# EasyEDA Pro project 3SE_24_Power_Rune.eprj, board Armour_Demo2.0
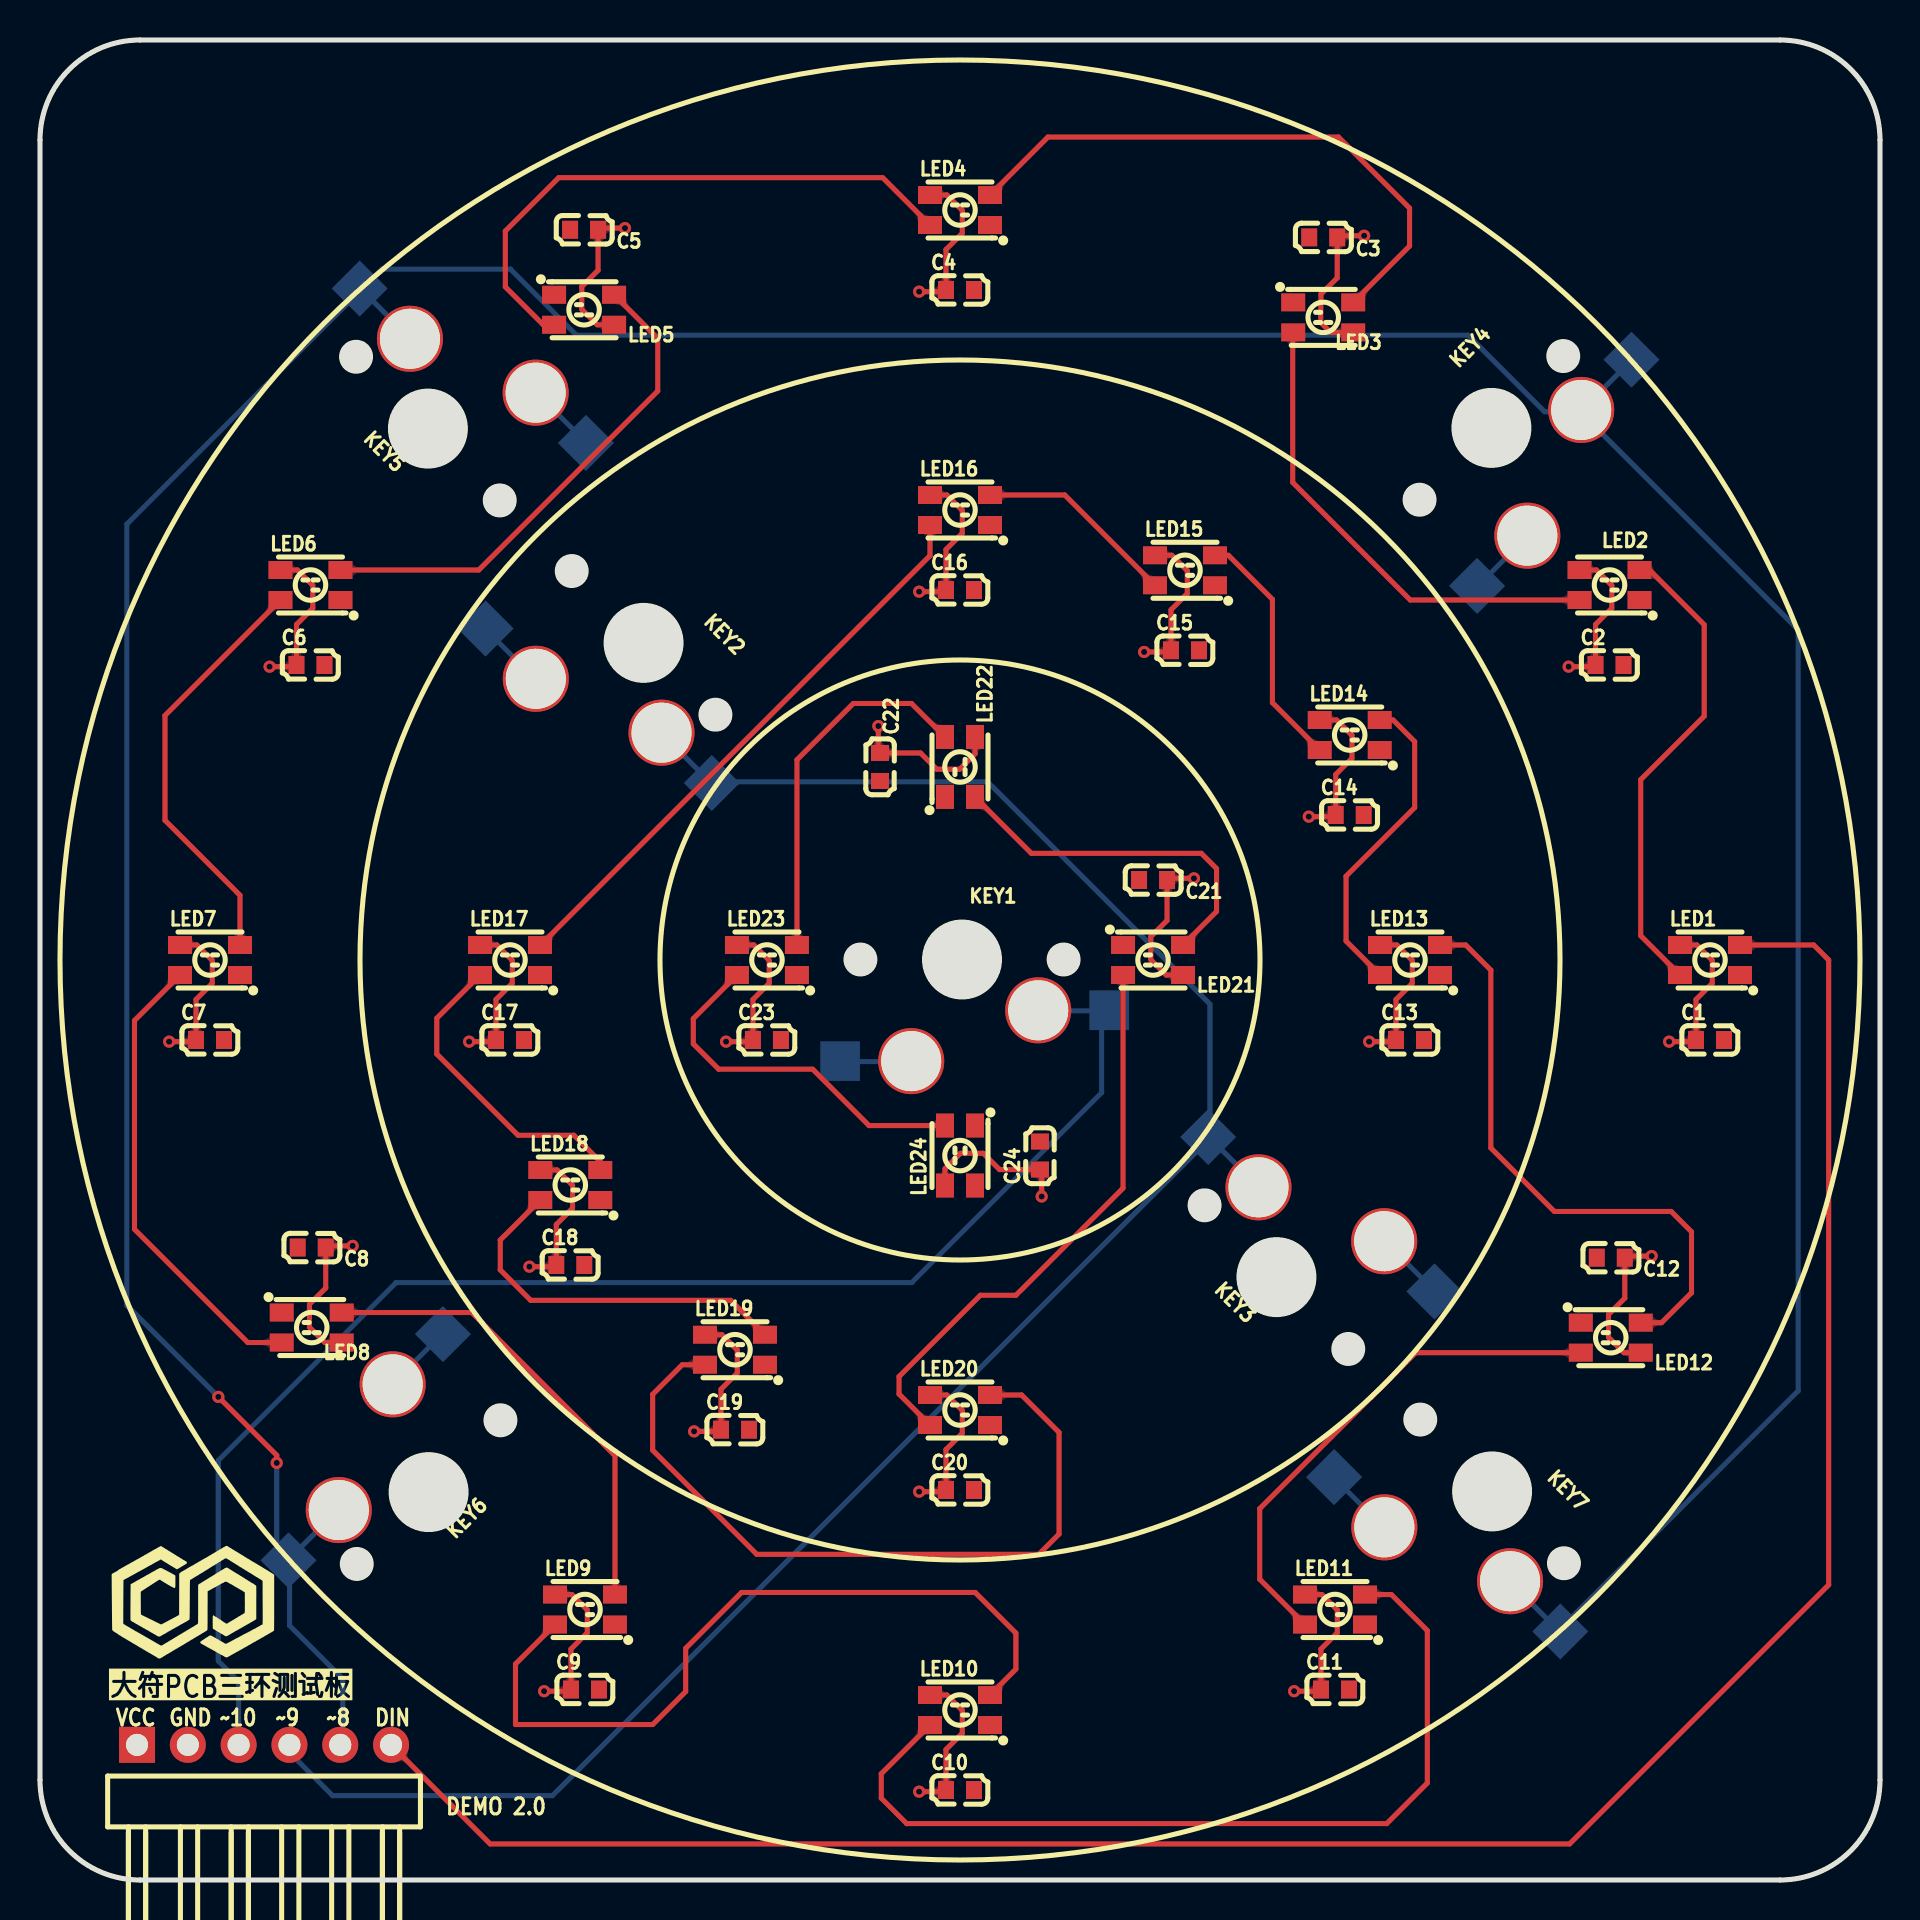
[diagram p13: board, top side]
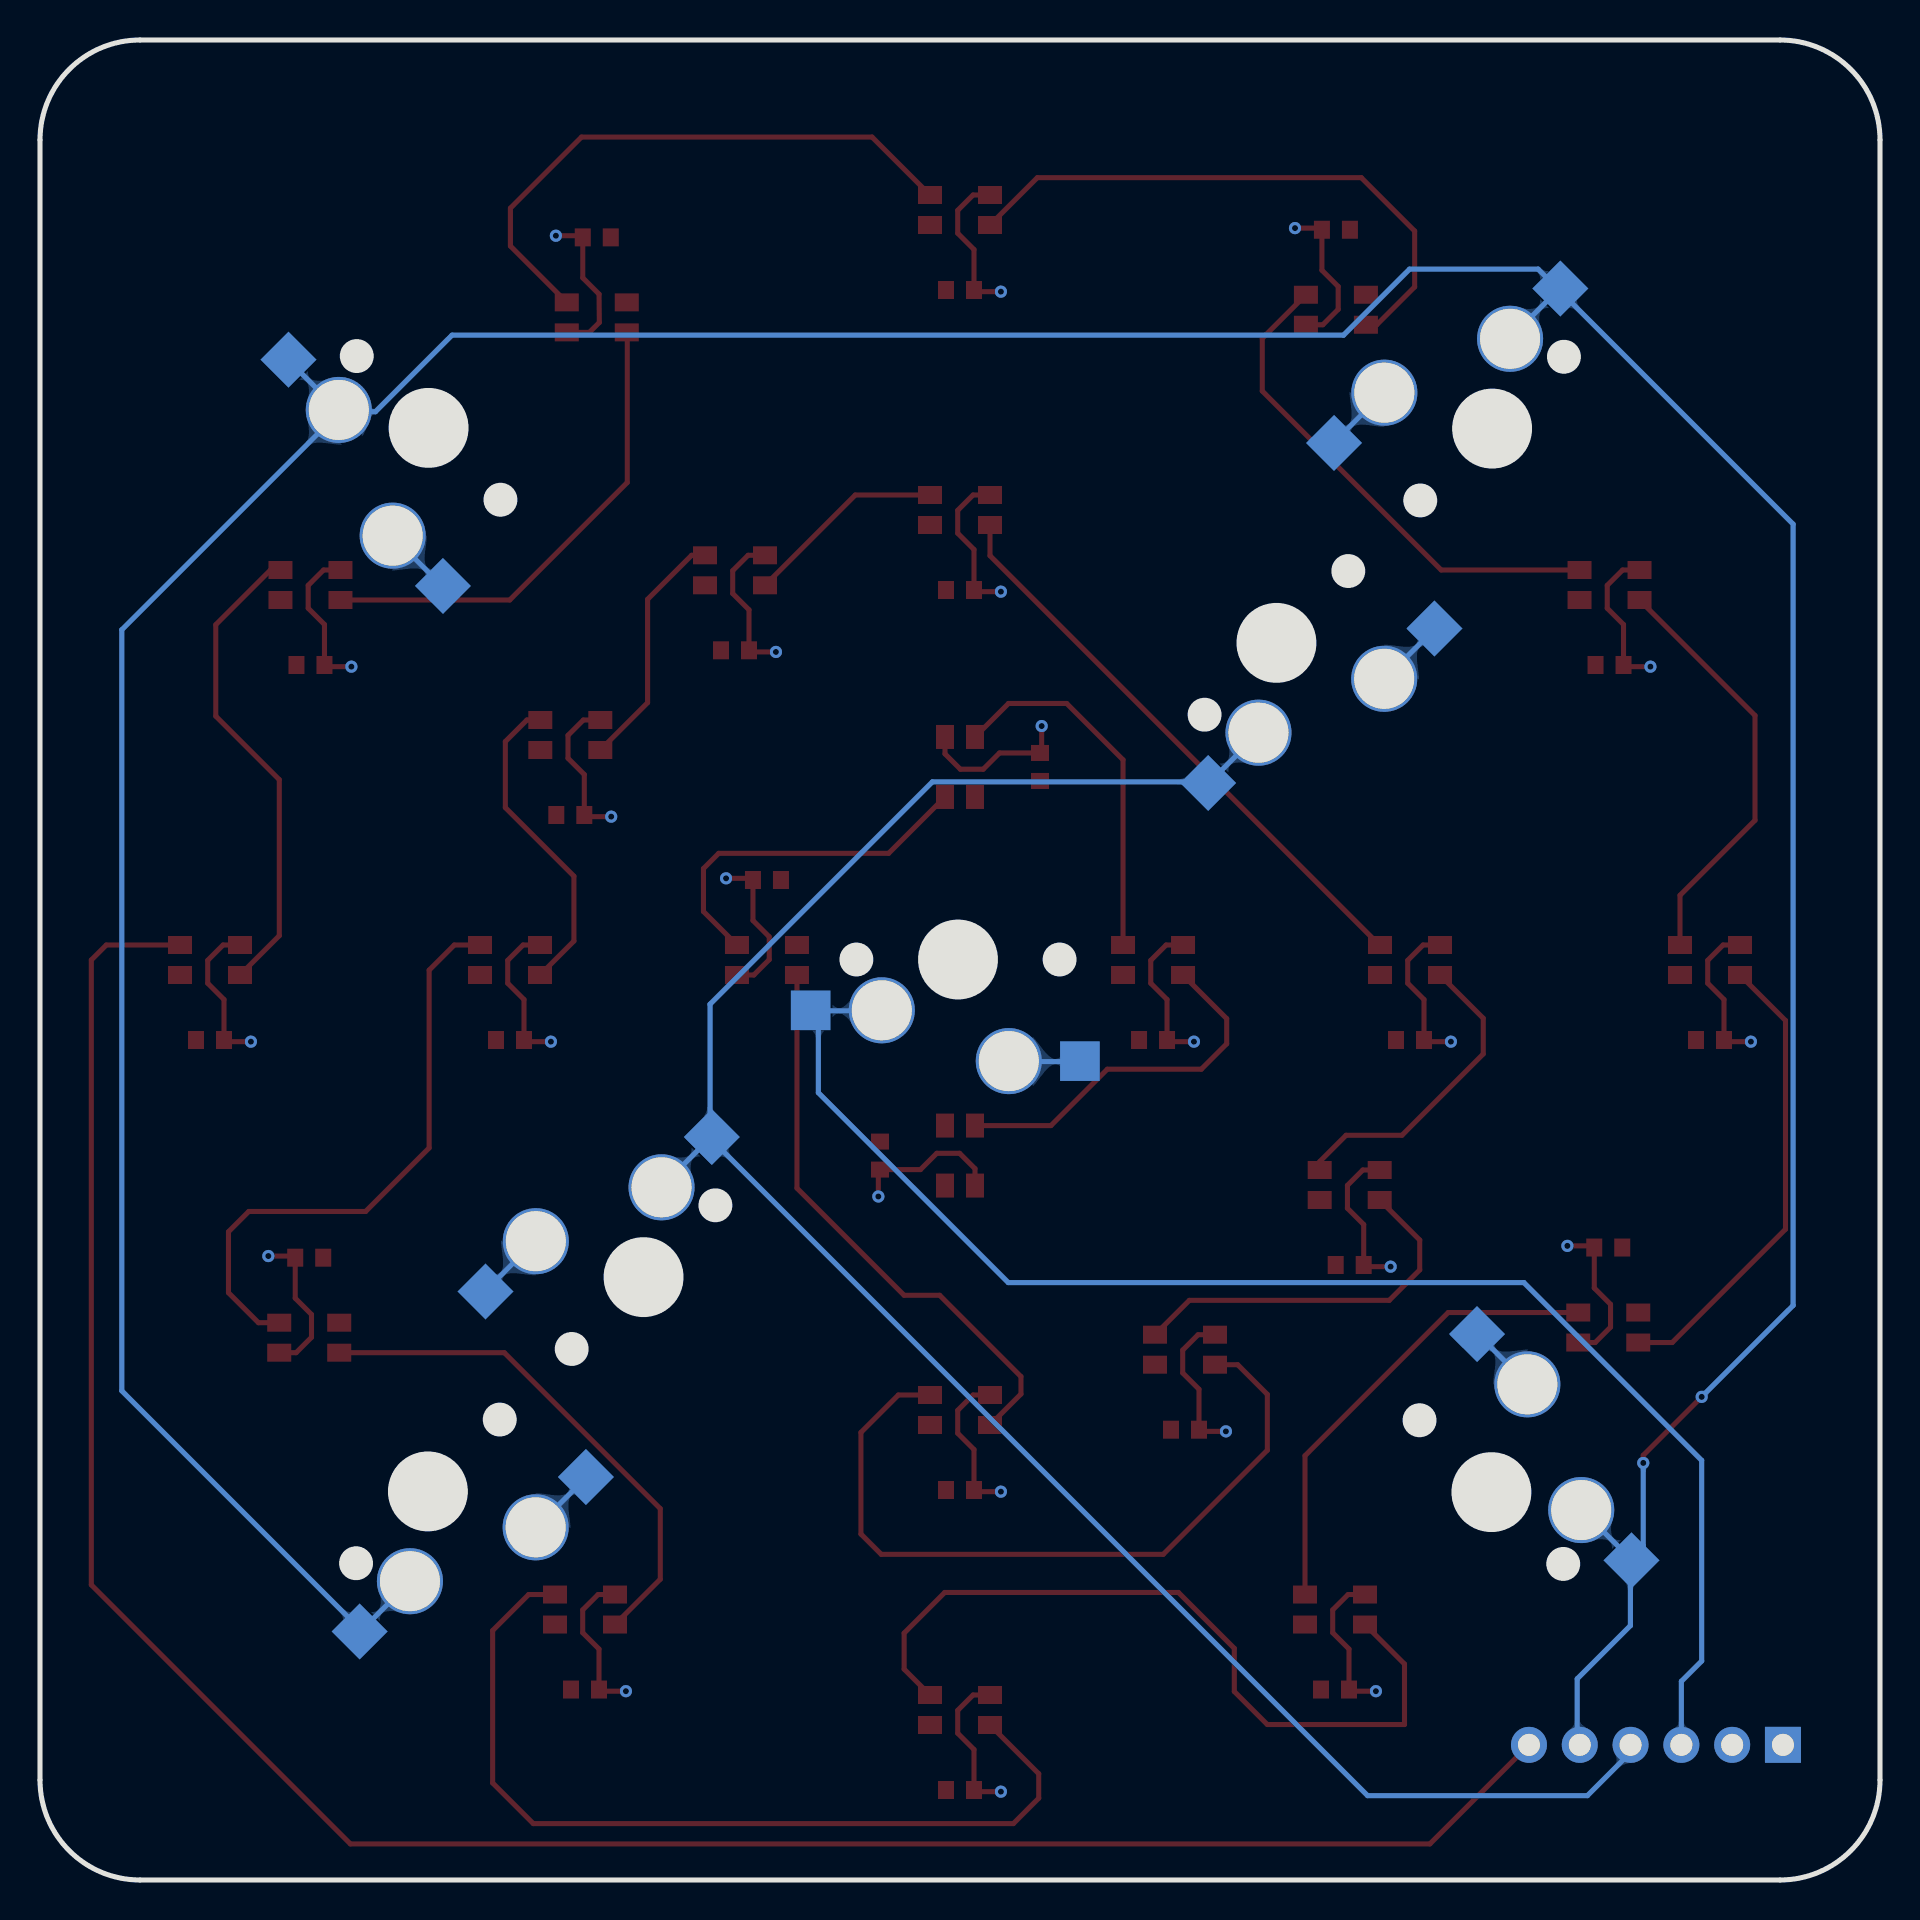
[diagram p14: board, bottom side, seen from below]

Outline 92 x 92 mm; copper layers: Top Layer, Bottom Layer. Coordinates in mm from the lower left corner of the outline.
Outline path: 0,87 0,5 arc(1.46,1.46) 5,0 87,0 arc(90.54,1.46) 92,5 92,87 arc(90.54,90.54) 87,92 5,92 arc(1.46,90.54) 0,87
Stack: Top Layer 0.035mm / Dielectric1 1.51mm FR4 er 4.5 / Bottom Layer 0.035mm

## Design rules (mm)
template: 自定义配置
spacing copperThickness1oz (default): track to track 0.102, other pairs 0.152 to 0.3
spacing copperThickness2oz: track to track 0.203, other pairs 0.152 to 0.3
track width copperThickness1oz (default): min 0.127, default 0.254, max 2.54
track width copperThickness2oz: min 0.203, default 0.254, max 2.54
differential pair differentialPair (default): width min 0.127, default 0.254, max 2.54; gap min 0.152, default 0.152
via viaSize (default): diameter min 0.5, default 0.61, max 10; hole min 0.3, default 0.305, max 6.3
net GND uses power
net VCC uses power

## Placement (name value [footprint] x y rotation side)
C1  100nF  [C0603]  83.5 42 0 top
C2  100nF  [C0603]  78.48 60.75 0 top
C3  100nF  [C0603]  64.16 82.13 180 top
C4  100nF  [C0603]  46 79.5 0 top
C5  100nF  [C0603]  27.2 82.51 180 top
C6  100nF  [C0603]  13.52 60.75 0 top
C7  100nF  [C0603]  8.5 42 0 top
C8  100nF  [C0603]  13.59 31.62 180 top
C9  100nF  [C0603]  27.25 9.52 0 top
C10  100nF  [C0603]  46 4.5 0 top
C11  100nF  [C0603]  64.75 9.52 0 top
C12  100nF  [C0603]  78.54 31.11 180 top
C13  100nF  [C0603]  68.5 42 0 top
C14  100nF  [C0603]  65.49 53.25 0 top
C15  100nF  [C0603]  57.25 61.49 0 top
C16  100nF  [C0603]  46 64.5 0 top
C17  100nF  [C0603]  23.5 42 0 top
C18  100nF  [C0603]  26.51 30.75 0 top
C19  100nF  [C0603]  34.75 22.51 0 top
C20  100nF  [C0603]  46 19.5 0 top
C21  100nF  [C0603]  55.65 50 180 top
C22  100nF  [C0603]  42 55.65 270 top
C23  100nF  [C0603]  36.35 42 0 top
C24  100nF  [C0603]  50 36.22 90 top
H1  PZ254R-11-06P  [HDR-TH_6P-P2.54-H-M-W10.4]  11.2 6.76 0 top
KEY1  -  [热插拔轴座]  46 46 0 top
KEY2  -  [热插拔轴座]  30.09 61.91 315 top
KEY3  -  [热插拔轴座]  61.91 30.09 135 top
KEY4  -  [热插拔轴座]  72.52 72.52 45 top
KEY5  -  [热插拔轴座]  19.48 72.52 135 top
KEY6  -  [热插拔轴座]  19.48 19.48 225 top
KEY7  -  [热插拔轴座]  72.52 19.48 315 top
LED1  XL-3528RGBW-WS2812B  [LED-SMD_4P-L3.5-W2.8-BR-1]  83.5 46 0 top
LED2  XL-3528RGBW-WS2812B  [LED-SMD_4P-L3.5-W2.8-BR-1]  78.48 64.75 0 top
LED3  XL-3528RGBW-WS2812B  [LED-SMD_4P-L3.5-W2.8-BR-1]  64.16 78.13 180 top
LED4  XL-3528RGBW-WS2812B  [LED-SMD_4P-L3.5-W2.8-BR-1]  46 83.5 0 top
LED5  XL-3528RGBW-WS2812B  [LED-SMD_4P-L3.5-W2.8-BR-1]  27.2 78.51 180 top
LED6  XL-3528RGBW-WS2812B  [LED-SMD_4P-L3.5-W2.8-BR-1]  13.52 64.75 0 top
LED7  XL-3528RGBW-WS2812B  [LED-SMD_4P-L3.5-W2.8-BR-1]  8.5 46 0 top
LED8  XL-3528RGBW-WS2812B  [LED-SMD_4P-L3.5-W2.8-BR-1]  13.59 27.62 180 top
LED9  XL-3528RGBW-WS2812B  [LED-SMD_4P-L3.5-W2.8-BR-1]  27.25 13.52 0 top
LED10  XL-3528RGBW-WS2812B  [LED-SMD_4P-L3.5-W2.8-BR-1]  46 8.5 0 top
LED11  XL-3528RGBW-WS2812B  [LED-SMD_4P-L3.5-W2.8-BR-1]  64.75 13.52 0 top
LED12  XL-3528RGBW-WS2812B  [LED-SMD_4P-L3.5-W2.8-BR-1]  78.54 27.12 180 top
LED13  XL-3528RGBW-WS2812B  [LED-SMD_4P-L3.5-W2.8-BR-1]  68.5 46 0 top
LED14  XL-3528RGBW-WS2812B  [LED-SMD_4P-L3.5-W2.8-BR-1]  65.49 57.25 0 top
LED15  XL-3528RGBW-WS2812B  [LED-SMD_4P-L3.5-W2.8-BR-1]  57.25 65.49 0 top
LED16  XL-3528RGBW-WS2812B  [LED-SMD_4P-L3.5-W2.8-BR-1]  46 68.5 0 top
LED17  XL-3528RGBW-WS2812B  [LED-SMD_4P-L3.5-W2.8-BR-1]  23.5 46 0 top
LED18  XL-3528RGBW-WS2812B  [LED-SMD_4P-L3.5-W2.8-BR-1]  26.51 34.75 0 top
LED19  XL-3528RGBW-WS2812B  [LED-SMD_4P-L3.5-W2.8-BR-1]  34.75 26.51 0 top
LED20  XL-3528RGBW-WS2812B  [LED-SMD_4P-L3.5-W2.8-BR-1]  46 23.5 0 top
LED21  XL-3528RGBW-WS2812B  [LED-SMD_4P-L3.5-W2.8-BR-1]  55.65 46 180 top
LED22  XL-3528RGBW-WS2812B  [LED-SMD_4P-L3.5-W2.8-BR-1]  46 55.65 270 top
LED23  XL-3528RGBW-WS2812B  [LED-SMD_4P-L3.5-W2.8-BR-1]  36.35 46 0 top
LED24  XL-3528RGBW-WS2812B  [LED-SMD_4P-L3.5-W2.8-BR-1]  46 36.22 90 top

## Footprints (pads in the part's own frame, mm; a bottom-side part is the same pattern mirrored in y, then rotated)
C0603
  rect 0.8x0.9 smd: 1(-0.7,0) 2(0.7,0)
HDR-TH_6P-P2.54-H-M-W10.4
  rect 1.8x1.8 hole 1.1: 1(-6.35,0)
  round 1.8 hole 1.1: 2(-3.81,0) 3(-1.27,0) 4(1.27,0) 5(3.81,0) 6(6.35,0)
LED-SMD_4P-L3.5-W2.8-BR-1
  rect 1.2x0.9 smd: 1(1.5,-0.75) 2(1.5,0.75) 3(-1.5,0.75) 4(-1.5,-0.75)
热插拔轴座
  rect 1.981x1.981 smd far side: 1(-5.995,-5.056) 2(7.466,-2.515)
  round 3.304 hole 3: 1(-2.439,-5.056) 2(3.91,-2.515)

## Nets
As in the schematic.

## Via types
v1: diameter 0.61, hole 0.305, Top Layer to Bottom Layer, 26 vias

## Routing (per net, layer and track width the routed paths; a pad name or vN(x,y) marks a point on that pad's centre or on a via; arc(x,y) is an arc through that point)
GND: length 24.9
  Bottom Layer w0.254: 69.81,29.37 67.3,31.89 ; 64.61,20.2 67.13,17.69 ; 22.19,62.63 24.7,60.11 ; 74.31,67.13 71.8,64.61 ; 27.39,71.8 24.87,74.31 ; 20.2,27.39 17.69,24.87 ; 43.46,40.92 39.9,40.92
VCC: length 183.3
  Top Layer w0.254: LED5.3 27.86,77.76 27.09,78.53 27.09,79.67 27.9,80.49 C5.1 27.99,82.59 v1(29.25,82.59) ; LED10.3 45.34,9.25 46.11,8.48 46.11,7.34 45.3,6.52 C10.1 45.22,4.42 v1(43.96,4.42) ; v1(21.45,41.92) 22.72,41.92 C17.1 22.8,44.02 23.61,44.84 23.61,45.98 22.84,46.75 LED17.3 ; v1(11.48,60.67) 12.74,60.67 C6.1 12.82,62.77 13.64,63.59 13.64,64.73 12.87,65.5 LED6.3 ; LED7.3 7.84,46.75 8.61,45.98 8.61,44.84 7.8,44.02 C7.1 7.72,41.92 v1(6.45,41.92) ; LED19.3 34.09,27.26 34.86,26.5 34.86,25.35 34.05,24.54 C19.1 33.97,22.43 v1(32.71,22.43) ; v1(34.3,41.92) 35.56,41.92 C23.1 35.65,44.02 36.46,44.84 36.46,45.98 35.69,46.75 LED23.3 ; v1(50.08,34.18) 50.08,35.44 C24.1 47.98,35.52 47.16,36.33 46.02,36.33 45.25,35.57 LED24.3 ; v1(41.92,57.7) 41.92,56.44 C22.1 44.02,56.35 44.84,55.54 45.98,55.54 46.75,56.31 LED22.3 ; LED16.3 45.34,69.25 46.11,68.48 46.11,67.34 45.3,66.52 C16.1 45.22,64.42 v1(43.96,64.42) ; v1(66.21,82.21) 64.94,82.21 C3.1 64.86,80.11 64.05,79.29 64.03,77.88 64.53,77.38 LED3.3 ; v1(25.21,9.44) 26.47,9.44 C9.1 26.55,11.55 27.36,12.36 27.36,13.5 26.59,14.27 LED9.3 ; v1(76.43,60.67) 77.69,60.67 C2.1 77.78,62.77 78.59,63.59 78.59,64.73 77.82,65.5 LED2.3 ; LED21.3 56.31,45.25 55.54,46.02 55.54,47.16 56.35,47.98 C21.1 56.44,50.08 v1(57.7,50.08) ; v1(62.71,9.44) 63.97,9.44 C11.1 64.05,11.55 64.86,12.36 64.86,13.5 64.09,14.27 LED11.3 ; LED8.3 14.24,26.87 13.47,27.64 13.47,28.78 14.29,29.6 C8.1 14.37,31.71 v1(15.63,31.71) ; v1(80.58,31.2) 79.32,31.2 79.24,31.11 79.24,29.09 78.43,28.28 78.43,27.13 79.19,26.37 LED12.3 ; LED1.3 82.84,46.75 83.61,45.98 83.61,44.84 82.8,44.02 C1.1 82.72,41.92 v1(81.46,41.92) ; LED14.3 64.83,58 65.6,57.23 65.6,56.09 64.79,55.27 C14.1 64.7,53.17 v1(63.44,53.17) ; v1(55.21,61.4) 56.47,61.4 C15.1 56.55,63.51 57.36,64.32 57.36,65.47 56.59,66.24 LED15.3 ; v1(66.46,41.92) 67.72,41.92 C13.1 67.8,44.02 68.61,44.84 68.61,45.98 67.84,46.75 LED13.3 ; LED4.3 45.34,84.25 46.11,83.48 46.11,82.34 45.3,81.52 C4.1 45.22,79.42 v1(43.96,79.42) ; LED18.3 25.86,35.5 26.63,34.73 26.63,33.59 25.81,32.77 C18.1 25.73,30.67 v1(24.47,30.67) ; v1(43.96,19.42) 45.22,19.42 C20.1 45.3,21.52 46.11,22.34 46.11,23.48 45.34,24.25 LED20.3
DIN1: length 115.3
  Top Layer w0.254: H1.6 22.5,1.8 76.48,1.8 89.43,14.76 89.43,46 88.68,46.75 LED1.2
KEY8: length 231.1
  Top Layer w0.254: v1(8.92,24.16) 11.84,21.24 v1(11.84,20.85)
  Bottom Layer w0.254: H1.5 15.14,6.88 15.14,10.06 12.48,12.72 12.48,16.07 ; 14.99,18.59 12.48,16.07 ; 12.48,16.07 11.84,16.71 v1(11.84,20.85) ; v1(8.92,24.16) 4.34,28.73 4.34,67.79 16.07,79.52 ; 16.07,79.52 17.09,80.54 23.52,80.54 26.82,77.24 71.4,77.24 75.23,73.41 77.01,73.41 ; 16.07,79.52 18.59,77.01 ; 77.01,73.41 79.52,75.93 ; 77.01,73.41 87.91,62.51 87.91,24.46 75.93,12.48 73.41,14.99
KEY9: length 104.3
  Bottom Layer w0.254: 30.99,57.42 33.5,54.91 47.38,54.91 58.5,43.79 58.5,37.09 ; H1.4 12.47,6.38 14.63,4.22 25.62,4.22 58.5,37.09 ; 58.5,37.09 61.01,34.58
KEY10: length 74.1
  Bottom Layer w0.254: 53.37,43.46 53.08,43.46 ; 53.08,43.46 49.81,43.46 ; 53.08,43.46 53.08,39.37 43.59,29.87 17.81,29.87 8.92,20.98 8.92,10.95 9.93,9.93 H1.3
$1N1766: length 24
  Top Layer w0.254: LED1.4 80.04,47.21 80.04,55.02 83.21,58.19 83.21,62.76 80.47,65.5 LED2.2
$1N1873: length 24.3
  Top Layer w0.254: LED3.2 62.64,77.36 62.64,69.88 68.51,64 LED2.4
$1N1984: length 29.5
  Top Layer w0.254: LED4.2 50.4,87.15 64.92,87.15 68.48,83.59 68.48,81.7 LED3.4
$1N6115: length 29.3
  Top Layer w0.254: LED4.4 42.13,85.12 25.93,85.12 23.27,82.45 23.27,79.66 25.16,77.76 LED5.2
$1N6897: length 23.4
  Top Layer w0.254: LED8.2 10.39,26.87 4.72,32.54 4.72,42.97 LED7.4
$1N6903: length 23.6
  Top Layer w0.254: LED8.4 21.59,28.37 28.75,21.21 LED9.2
$1N6915: length 39.3
  Top Layer w0.254: LED9.4 23.78,10.8 23.78,7.77 30.63,7.77 32.28,9.42 32.28,11.58 35.08,14.38 46.76,14.38 48.79,12.34 48.79,10.54 LED10.2
$1N6929: length 21.2
  Top Layer w0.254: LED7.2 10,49.23 6.25,52.98 6.25,58.22 LED6.4
$1N6940: length 25.3
  Top Layer w0.254: LED6.2 21.94,65.5 30.89,74.45 30.89,77.08 LED5.4
$1N7432: length 29.9
  Top Layer w0.254: LED12.4 81.08,27.87 82.58,29.36 82.58,32.41 81.56,33.43 75.72,33.43 72.54,36.6 72.54,45.49 71.28,46.75 LED13.2
$1N7438: length 16
  Top Layer w0.254: LED14.2 67.66,58 68.73,56.92 68.73,53.62 65.3,50.19 65.3,46.95 LED13.4
$1N7450: length 12.3
  Top Layer w0.254: LED15.2 59.42,66.24 61.62,64.03 61.62,58.86 LED14.4
$1N7454: length 26
  Top Layer w0.254: LED12.2 68.78,26.37 60.99,18.57 60.99,15.04 LED11.4
$1N7458: length 44.8
  Top Layer w0.254: LED11.2 67.57,14.27 69.37,12.47 69.37,4.85 67.34,2.82 43.33,2.82 42.06,4.09 42.06,5.31 LED10.4
$1N7998: length 15.7
  Top Layer w0.254: LED18.2 28.01,35.92 26.7,37.24 23.9,37.24 19.84,41.3 19.84,43.09 LED17.4
$1N8004: length 18.9
  Top Layer w0.254: LED19.2 34.53,28.98 24.54,28.98 23.01,30.51 23.01,32 LED18.4
$1N8016: length 38.2
  Top Layer w0.254: LED19.4 32.11,25.76 30.63,24.28 30.63,21.49 35.84,16.28 49.94,16.28 50.95,17.3 50.95,22.38 49.08,24.25 LED20.2
$1N8020: length 29.1
  Top Layer w0.254: LED16.4 44.5,66.22 25.03,46.75 LED17.2
$1N8024: length 10.1
  Top Layer w0.254: LED16.2 51.24,69.25 LED15.4
$1N8502: length 18.5
  Top Layer w0.254: LED22.4 43.57,58.83 40.67,58.83 37.85,56.01 LED23.2
$1N8508: length 18.6
  Top Layer w0.254: LED24.2 41.45,37.72 38.63,40.54 33.94,40.54 32.66,41.81 32.66,43.07 LED23.4
$1N8524: length 18.1
  Top Layer w0.254: LED22.2 49.57,51.33 58.06,51.33 58.83,50.57 58.83,48.42 LED21.4
$1N8528: length 28.8
  Top Layer w0.254: LED20.4 42.95,24.3 42.95,25.17 47.02,29.24 48.79,29.24 54.15,34.59 LED21.2

## Copper pours and planes (outline as drawn; the poured copper is in the pictures)
GND on Top Layer: -1.24,94.13 93.5,94.13 93.5,-2.26 -1.24,-2.26
VCC on Bottom Layer: -3.66,93.37 96.16,93.37 96.16,-2.9 -3.66,-2.9

Small or netless copper shapes (teardrops, artwork), in the pictures only: 142 on Top Layer, 44 on Bottom Layer

## Text on the board
Top Silkscreen Layer: VCC | GND | ~10 | ~9 | ~8 | DIN | DEMO 2.0 | 大符PCB三环测试板
